# EasyEDA Pro project 电脑鼠SYR.eprj, board PCB1
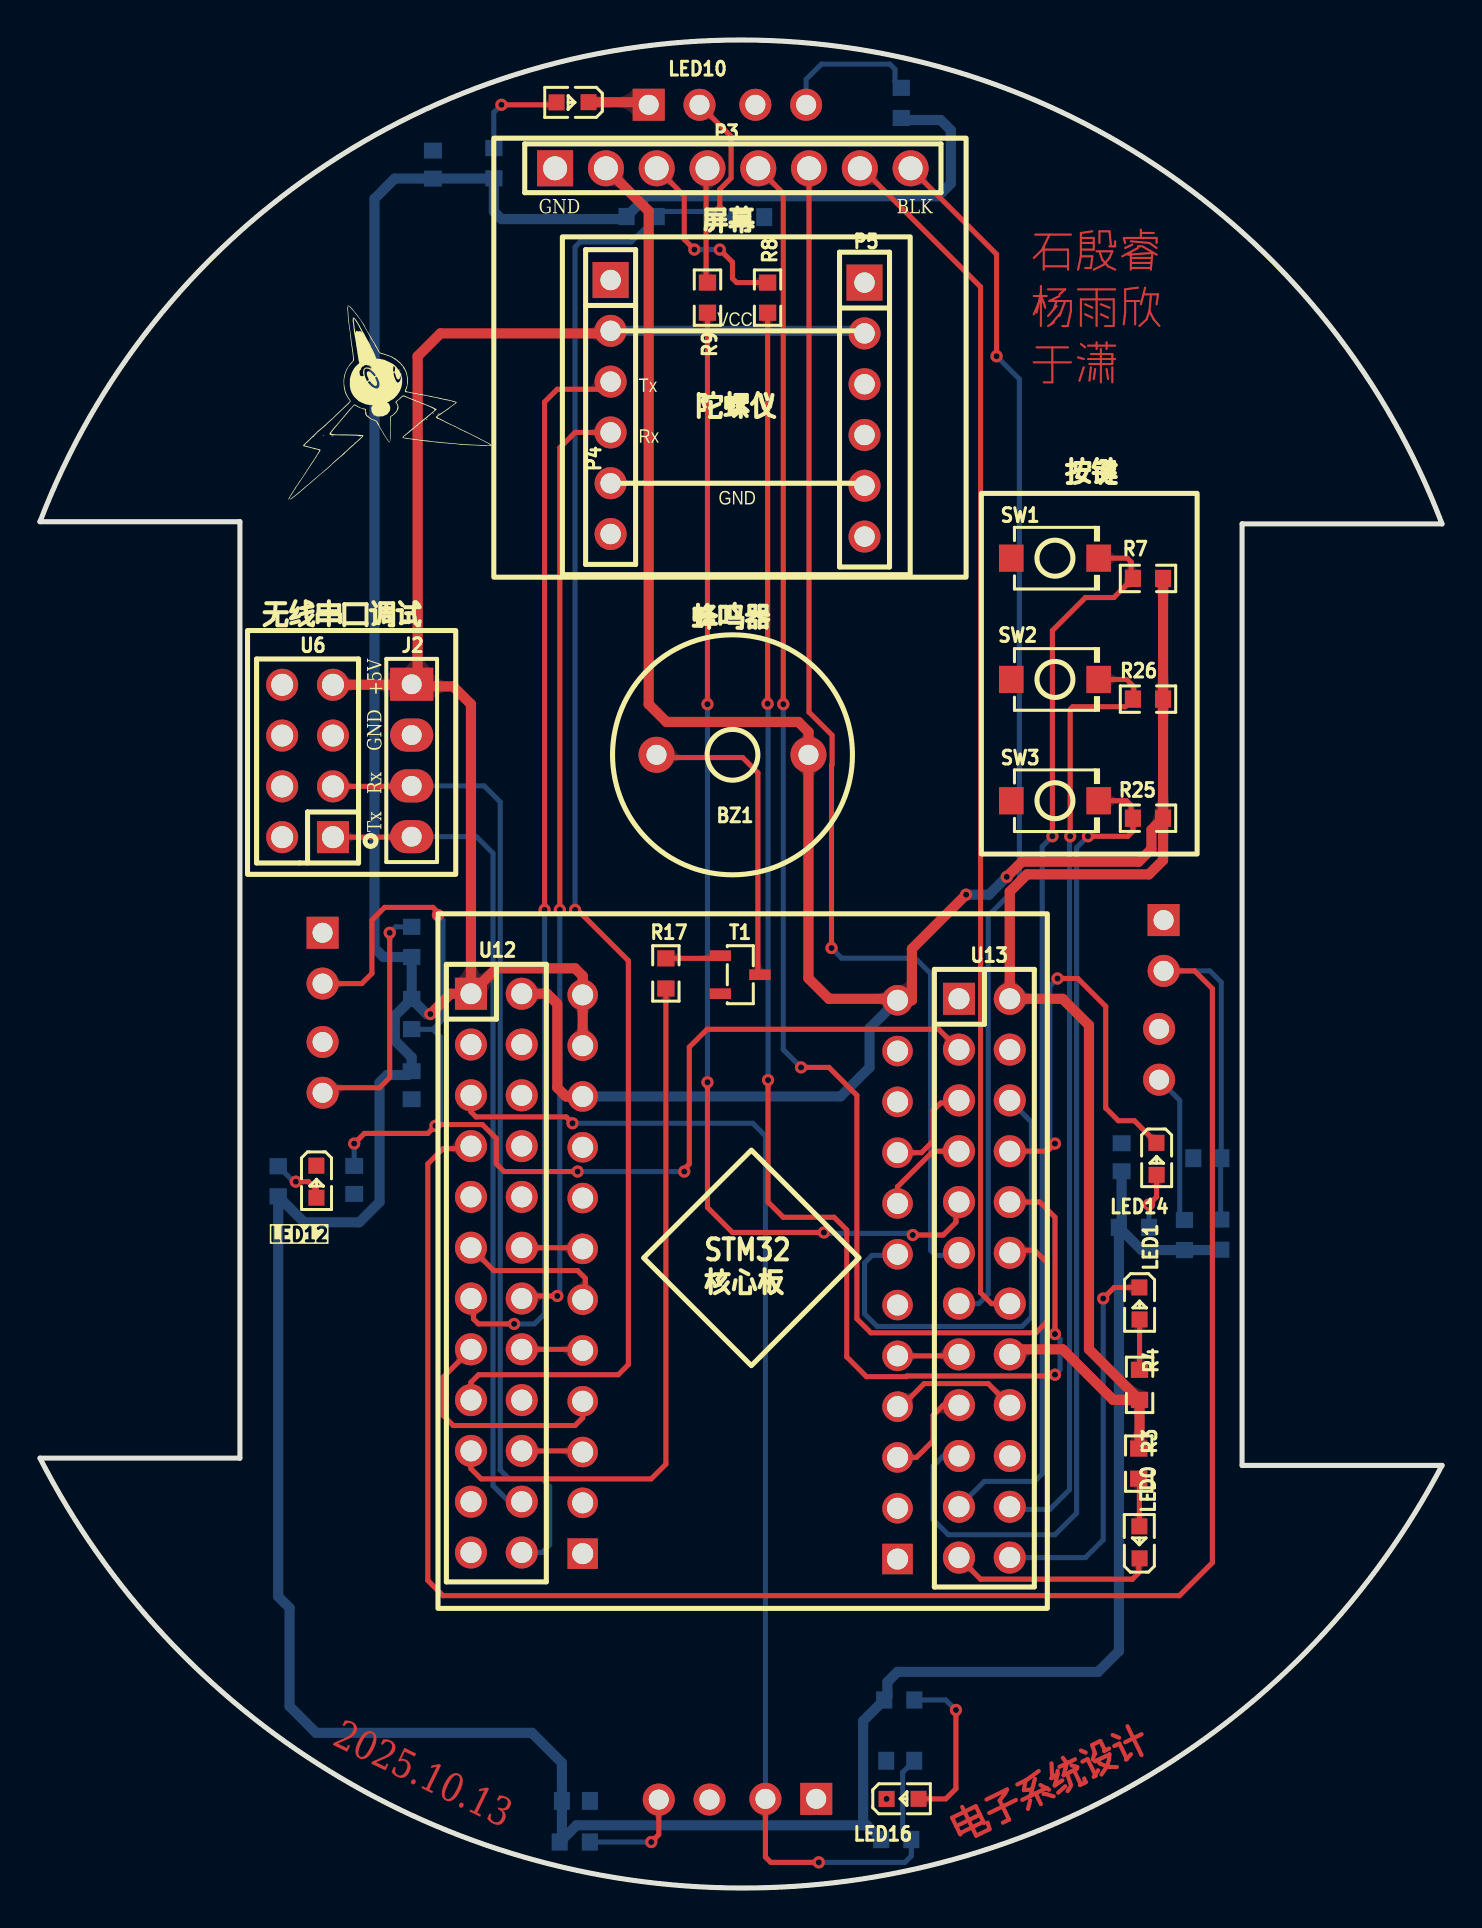
[diagram p2: board, top side]
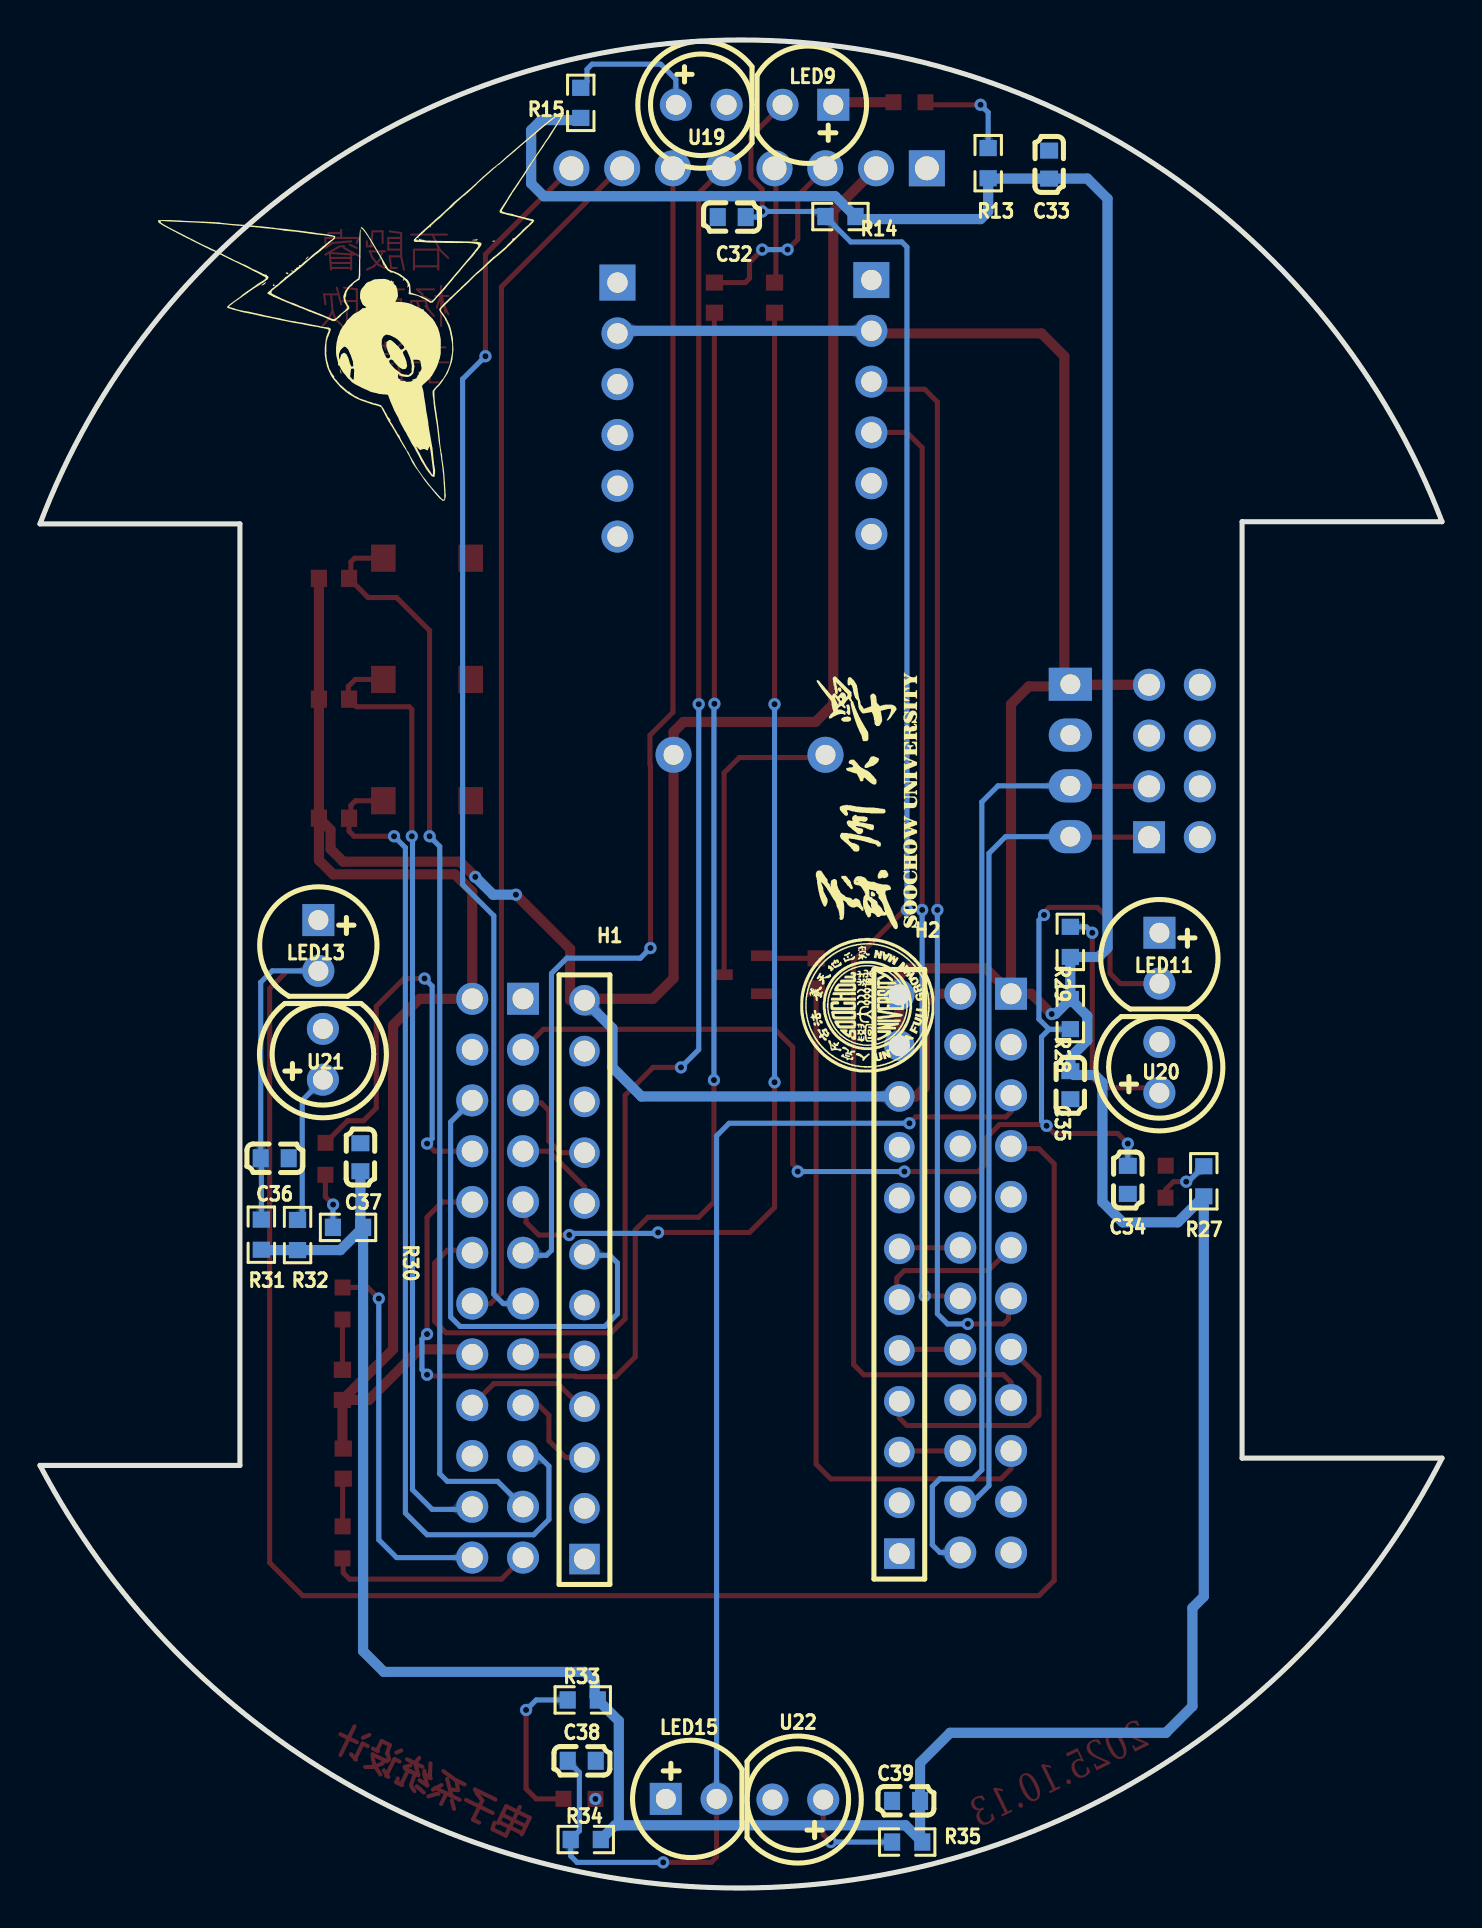
[diagram p3: board, bottom side, seen from below]

Outline 70.13 x 92.41 mm; copper layers: Top Layer, Bottom Layer. Coordinates in mm from the lower left corner of the outline.
Outline path: 0,68.32 arc(35.1,92.41) 70.13,68.21 60.13,68.21 60.13,21.13 70.13,21.13 arc(34.95,0) 0,21.49 10,21.49 10,68.32 0,68.32
Stack: Top Layer 0.035mm / Dielectric1 1.51mm FR4 er 4.5 / Bottom Layer 0.035mm

## Design rules (mm)
template: 自定义配置
spacing copperThickness1oz (default): track to track 0.102, other pairs 0.152 to 0.3
spacing copperThickness2oz: track to track 0.203, other pairs 0.152 to 0.3
track width copperThickness1oz (default): min 0.127, default 0.254, max 2.54
track width copperThickness2oz: min 0.381, default 0.381, max 2.54
differential pair differentialPair (default): width min 0.127, default 0.254, max 2.54; gap min 0.152, default 0.152
via viaSize (default): diameter min 0.5, default 0.61, max 10; hole min 0.3, default 0.305, max 6.299
net +5V uses copperThickness2oz
net 3V3 uses copperThickness2oz

## Placement (name value [footprint] x y rotation side)
BZ1  2.7kHz  [BUZ-TH_BD12.0-P7.60-D0.6-FD]  34.64 56.66 180 top
C32  104  [C0603]  35.53 83.55 180 bottom
C33  104  [C0603]  19.65 86.18 270 bottom
C34  104  [C0603]  15.72 35.41 90 bottom
C35  104  [C0603]  18.59 40.14 90 bottom
C36  104  [C0603]  58.39 36.49 0 bottom
C37  104  [C0603]  54.1 36.54 270 bottom
C38  104  [C0603]  43.03 6.36 0 bottom
C39  104  [C0603]  26.81 4.36 180 bottom
H1  -  [HDR-TH_12P-P2.54-V-M]  42.89 30.42 90 bottom
H2  -  [HDR-TH_12P-P2.54-V-M]  27.14 30.69 90 bottom
J2  null  [HEADER1X4]  18.72 56.38 270 top
LED0  XL-1608SURC-06  [LED0603-RD_RED]  54.99 17.28 90 top
LED1  XL-1608SURC-06  [LED0603-RD_RED]  54.99 29.23 270 top
LED9  MHL524PT03BRT  [LED-TH_BD5.8-P2.54-RD]  31.72 89.17 0 bottom
LED10  XL-1608SURC-06  [LED0603-RD_RED]  26.64 89.29 180 top
LED11  MHL524PT03BRT  [LED-TH_BD5.8-P2.54-RD]  14.13 46.49 270 bottom
LED12  XL-1608SURC-06  [LED0603-RD_RED]  13.83 35.32 270 top
LED13  MHL524PT03BRT  [LED-TH_BD5.8-P2.54-RD]  56.2 47.13 270 bottom
LED14  XL-1608SURC-06  [LED0603-RD_RED]  55.85 36.46 270 top
LED15  MHL524PT03BRT  [LED-TH_BD5.8-P2.54-RD]  37.55 4.46 180 bottom
LED16  XL-1608SURC-06  [LED0603-RD_RED]  43.14 4.46 0 top
P3  null  [HDR-TH_8P-P2.54-V-F-1]  34.66 85.99 0 top
P4  2.54-1*6P母  [HDR-TH_6P-P2.54-V-F]  28.54 74.05 270 top
P5  2.54-1*6P母  [HDR-TH_6P-P2.54-V-F]  41.24 73.93 270 top
R3  4.7kΩ  [R0603]  54.96 21.22 270 top
R4  4.7kΩ  [R0603]  55 25.16 90 top
R7  4.7kΩ  [R0603]  55.42 65.48 0 top
R8  100Ω  [R0603]  36.39 79.52 270 top
R9  100Ω  [R0603]  33.39 79.52 270 top
R13  1K  [R0603]  22.7 86.25 270 bottom
R14  10K  [R0603]  30.09 83.58 180 bottom
R15  100  [R0603]  43.08 89.26 270 bottom
R17  100Ω  [R0603]  31.31 45.73 90 top
R25  4.7kΩ  [R0603]  55.42 53.49 0 top
R26  4.7kΩ  [R0603]  55.42 59.45 0 top
R27  1K  [R0603]  11.92 35.34 270 bottom
R28  10K  [R0603]  18.59 43.7 90 bottom
R29  100  [R0603]  18.59 47.31 270 bottom
R30  1K  [R0603]  54.72 33.03 180 bottom
R31  10K  [R0603]  59.05 32.67 270 bottom
R32  100  [R0603]  57.24 32.65 270 bottom
R33  1K  [R0603]  42.98 9.4 180 bottom
R34  10K  [R0603]  42.83 2.42 180 bottom
R35  100  [R0603]  26.75 2.3 180 bottom
SW1  TS-1088-AR02016  [SW-SMD_L3.9-W3.0-P4.45]  50.77 66.49 0 top
SW2  TS-1088-AR02016  [SW-SMD_L3.9-W3.0-P4.45]  50.77 60.43 0 top
SW3  TS-1088-AR02016  [SW-SMD_L3.9-W3.0-P4.45]  50.77 54.37 0 top
T1  S8050  [SOT-23-3_L2.9-W1.3-P1.90-LS2.3-BR]  35.02 45.67 180 top
U6  null  [HDR-TH_8P-P2.54-V-F-R2-C4-S2.54-1]  13.38 56.35 90 top
U12  null  [HDR-TH_24P-P2.54-V-F-R2-C12-S2.54-2]  22.83 30.75 270 top
U13  null  [HDR-TH_24P-P2.54-V-F-R2-C12-S2.54-2]  47.24 30.49 270 top
U19  IR333C-A(BY)(Q)  [LED-TH_BD5.0-P2.54-FD]  37.05 89.17 180 bottom
U20  IR333C-A(BY)(Q)  [LED-TH_BD5.0-P2.54-FD]  14.14 41.03 90 bottom
U21  IR333C-A(BY)(Q)  [LED-TH_BD5.0-P2.54-FD]  55.98 41.69 90 bottom
U22  IR333C-A(BY)(Q)  [LED-TH_BD5.0-P2.54-FD]  32.22 4.42 0 bottom

## Footprints (pads in the part's own frame, mm; a bottom-side part is the same pattern mirrored in y, then rotated)
BUZ-TH_BD12.0-P7.60-D0.6-FD
  round 1.8 hole 1: 1(-3.8,0) 2(3.8,0)
C0603
  rect 0.8x0.9 smd: 1(-0.7,0) 2(0.7,0)
HDR-TH_6P-P2.54-V-F
  rect 1.8x1.8 hole 1.02: 1(-6.35,0)
  round 1.6 hole 1.02: 2(-3.81,0) 3(-1.27,0) 4(1.27,0) 5(3.81,0) 6(6.35,0)
HDR-TH_8P-P2.54-V-F-1
  rect 1.8x1.8 hole 1.2: 1(-8.89,0)
  round 1.8 hole 1.2: 2(-6.35,0) 3(-3.81,0) 4(-1.27,0) 5(1.27,0) 6(3.81,0) 7(6.35,0) 8(8.89,0)
HDR-TH_8P-P2.54-V-F-R2-C4-S2.54-1
  rect 1.6x1.6 hole 1.1: 1(-3.81,-1.27)
  round 1.6 hole 1.1: 2(-3.81,1.27) 3(-1.27,-1.27) 4(-1.27,1.27) 5(1.27,-1.27) 6(1.27,1.27) 7(3.81,-1.27) 8(3.81,1.27)
HDR-TH_12P-P2.54-V-M
  rect 1.524x1.524 hole 1.05: 1(-13.97,0)
  round 1.524 hole 1.05: 2(-11.43,0) 3(-8.89,0) 4(-6.35,0) 5(-3.81,0) 6(-1.27,0) 7(1.27,0) 8(3.81,0) 9(6.35,0) 10(8.89,0) 11(11.43,0) 12(13.97,0)
HDR-TH_24P-P2.54-V-F-R2-C12-S2.54-2
  rect 1.6x1.6 hole 1.05: 1(-13.97,-1.27)
  round 1.6 hole 1.05: 2(-13.97,1.27) 3(-11.43,-1.27) 4(-11.43,1.27) 5(-8.89,-1.27) 6(-8.89,1.27) 7(-6.35,-1.27) 8(-6.35,1.27) 9(-3.81,-1.27) 10(-3.81,1.27) 11(-1.27,-1.27) 12(-1.27,1.27) 13(1.27,-1.27) 14(1.27,1.27) 15(3.81,-1.27) 16(3.81,1.27) 17(6.35,-1.27) 18(6.35,1.27) 19(8.89,-1.27) 20(8.89,1.27) 21(11.43,-1.27) 22(11.43,1.27) 23(13.97,-1.27) 24(13.97,1.27)
HEADER1X4
  rect 1.651x2.159 hole 0.991x0.996: 1(-3.81,-0.127)
  oval 1.651x2.159 hole 0.991x0.996: 2(-1.27,-0.127) 3(1.27,-0.127) 4(3.81,-0.127)
LED0603-RD_RED
  rect 0.8x0.8 smd: 1(-0.799,-0.004) 2(0.799,0.004)
LED-TH_BD5.0-P2.54-FD
  round 1.6 hole 1: 1(-1.27,0) 2(1.27,0)
LED-TH_BD5.8-P2.54-RD
  round 1.6 hole 1: 1(1.27,0)
  rect 1.6x1.6 hole 1: 2(-1.27,0)
R0603
  rect 0.806x0.864 smd: 1(-0.753,0) 2(0.753,0)
SOT-23-3_L2.9-W1.3-P1.90-LS2.3-BR
  rect 1.07x0.532 smd: 1(0.99,-0.95) 2(0.99,0.95) 3(-0.99,0)
SW-SMD_L3.9-W3.0-P4.45
  rect 1.23x1.36 smd: 1(-2.185,0) 2(2.185,0)

## Nets
As in the schematic.

Pads without a net: P4 1 6; P5 1 3 4 6; U6 2 4 8

## Via types
v1: diameter 0.61, hole 0.305, Top Layer to Bottom Layer, 43 vias

## Routing (per net, layer and track width the routed paths; a pad name or vN(x,y) marks a point on that pad's centre or on a via; arc(x,y) is an arc through that point)
3V3: length 161.3
  Top Layer w0.508: R25.2 55.59,52.91 55.59,51.95 54.96,51.32 49.12,51.32 v1(48.35,50.56) ; R25.2 R26.2 R7.2 ; R25.2 56.17,51.39 55.47,50.68 49.37,50.68 48.51,49.82 U13.2 51.15,44.46 52.47,43.14 52.47,26.93 R4.1 ; R3.1 55,22.01 R4.1 ; U12.2 25.37,44.72 25.88,44.21 25.88,40.02 26.31,39.58 H2.10 ; v1(46.32,49.67) 43.61,46.96 43.61,44.39 H1.12 42.82,44.46 39.46,44.46 38.44,45.49 BZ1.1 38.44,57.81 37.94,58.3 31.34,58.3 30.45,59.19 30.45,83.85 P3.2 ; R4.1 53.68,24.4 51.15,26.94 48.76,26.94 U13.16
  Bottom Layer w0.508: v1(46.32,49.67) 47.47,49.67 v1(48.35,50.56) ; H1.12 41.5,42.99 41.5,41.03 40.04,39.58 H2.10
+5V: length 282.3
  Top Layer w0.508: P4.2 28.42,77.74 20.03,77.74 18.89,76.59 18.89,60.49 J2.1 ; U12.1 20.54,44.72 v1(19.53,43.7) ; U12.1 22.83,45.99 26.76,45.99 27.14,45.6 H2.12 H2.11 ; U12.1 21.56,59.19 20.67,60.08 18.7,60.08 J2.1 ; J2.1 18.57,60.16 14.65,60.16
  Bottom Layer w0.508: R30.2 55.1,31.9 R32.2 59.04,31.9 R31.2 ; R30.2 54.1,33.17 C37.2 ; R30.2 53.97,11.85 52.93,10.81 42.89,10.81 42.39,10.3 42.39,9.56 R33.2 41.17,8.35 41.17,3.14 ; P5.2 41.11,77.86 P4.2 ; 26.11,2.41 26,2.3 ; 26.11,2.41 26.84,3.14 41.17,3.14 ; 26.11,2.41 C39.2 26.11,6.26 24.61,7.76 13.81,7.76 12.48,9.08 12.48,14 11.92,14.57 R27.2 13.21,33.29 15.97,33.29 16.98,34.3 16.98,40.27 17.37,40.65 18.4,40.65 C35.2 18.59,41.54 17.75,42.38 17.75,43.61 R28.2 ; R28.2 19.34,43.7 v1(19.53,43.7) ; R28.2 R29.2 17.18,46.55 16.73,47 16.73,84.47 17.74,85.48 C33.2 22.68,85.48 R13.2 22.7,83.83 23.08,83.45 29.21,83.45 R14.2 30.35,84.59 44.92,84.59 45.56,85.23 45.56,87.9 45.05,88.4 43.18,88.4 R15.2 ; 41.17,3.14 41.36,3.14 R34.2
GND: length 25.3
  Top Layer w0.254: LED14.1 54.74,38.37 53.94,38.37 53.31,39 53.31,44.08 51.91,45.48 v1(50.89,45.48) ; U13.8 50.39,36.84 v1(50.77,37.22)
  Top Layer w0.508: LED10.1 30.32,89.3 LED9.2
  Bottom Layer w0.254: v1(50.77,37.22) 50.51,37.48 50.51,45.1 v1(50.89,45.48)
  vias: v1(42.34,4.45)
BAT_ADC: length 3.1
  Top Layer w0.254: H2.3 27.09,21.86 U12.20
BEEP: length 34.9
  Top Layer w0.254: R17.1 31.31,21.19 30.57,20.46 22.07,20.46 21.56,20.97 U12.19
DETECT0: length 81.3
  Top Layer w0.254: U12.17 21.56,25.28 21.94,25.67 28.92,25.67 29.43,26.17 29.43,46.37 26.89,48.91 v1(26.76,48.91) ; LED9.1 34.57,87.59 34.57,85.5 34,84.94 v1(34,83.83)
  Bottom Layer w0.254: C32.2 34.28,83.55 v1(34,83.83) 31.1,83.83 R14.1 29.57,82.31 27.02,82.31 26.76,82.05 v1(26.76,48.91)
DETECT1: length 61.7
  Top Layer w0.254: v1(19.91,48.65) 19.91,48.78 19.65,49.03 17.24,49.03 16.6,48.4 16.6,45.73 16.1,45.22 LED11.1 ; v1(26.89,35.83) 23.21,35.83 22.83,36.21 22.83,37.48 22.13,38.18 19.84,38.18 v1(19.78,38.11) 19.4,37.73 16.22,37.73 v1(15.72,37.22) ; v1(32.23,35.83) 32.23,35.95 32.48,36.21 32.48,42.05 33.37,42.94 44.95,42.94 45.97,41.92
  Bottom Layer w0.254: v1(19.91,48.65) 20.16,48.4 20.16,43.45 19.65,42.94 ; 19.65,42.94 20.03,42.56 20.03,38.37 v1(19.78,38.11) ; 19.65,42.94 18.6,42.94 R28.1 ; v1(32.23,35.83) v1(26.89,35.83) ; v1(15.72,37.22) C34.2
DETECT2: length 110.1
  Top Layer w0.254: LED13.1 57.75,45.86 58.64,44.97 58.64,16.27 56.99,14.62 20.16,14.62 19.4,15.38 19.4,36.21 20.16,36.97 21.43,36.97 21.56,37.1
  Bottom Layer w0.254: LED13.1 58.51,45.86 59.09,45.29 C36.2 59.05,36.46 R31.1
DETECT3: length 64.8
  Top Layer w0.254: v1(26.64,38.24) 26.32,38.56 21.81,38.56 21.56,38.81 U12.5 ; LED15.1 36.29,1.55 36.55,1.28 v1(38.96,1.28)
  Bottom Layer w0.254: C38.2 43.15,5.78 43.15,2.86 R34.1 43.58,1.6 43.26,1.28 v1(38.96,1.28) ; v1(26.64,38.24) 35.65,38.24 36.29,37.61 LED15.1
DIR_L1: length 3.1
  Top Layer w0.254: H1.5 45.89,26.61 U13.15
DIR_L2: length 6.5
  Top Layer w0.254: H1.4 43.07,24.07 44.23,25.22 47.43,25.22 48.51,24.14
DIR_R1: length 24.5
  Bottom Layer w0.254: H1.7 42.84,31.63 41.62,31.63 41.24,31.25 41.24,28.71 41.88,28.08 49.12,28.08 49.59,28.55 49.59,38.3 U13.6
DIR_R2: length 4.6
  Top Layer w0.254: U13.7 44.67,36.84 42.89,35.06 H1.8
ENC_LA: length 3.1
  Top Layer w0.254: U12.16 27.09,26.94 H2.5
ENC_LB: length 12.1
  Top Layer w0.254: H2.4 27.14,23.51 26.76,23.13 20.67,23.13 20.16,23.63 20.16,25.54 U12.15
ENC_RA: length 3.1
  Top Layer w0.254: H2.7 27.09,32.02 24.1,32.02
ENC_RB: length 7.5
  Top Layer w0.254: 21.56,32.02 22.7,30.87 26.89,30.87 27.27,30.49 27.27,29.55 H2.6
IMU_RX1: length 47.2
  Top Layer w0.254: P4.4 26.76,72.78 26,72.02 v1(26,48.91) ; U12.14 24.22,29.6 v1(25.88,29.6)
  Bottom Layer w0.254: v1(25.88,29.6) 26,29.73 v1(26,48.91)
IMU_TX1: length 54.3
  Top Layer w0.254: v1(25.24,48.91) 25.24,74.31 25.88,74.94 28.16,74.94 P4.3 ; U12.13 21.68,29.35 21.68,28.45 21.93,28.21 v1(23.72,28.21)
  Bottom Layer w0.254: v1(25.24,48.91) 25.24,28.71 24.73,28.21 v1(23.72,28.21)
KEY0: length 54.9
  Top Layer w0.254: v1(50.64,52.59) 50.64,62.88 52.29,64.53 53.71,64.53 R7.1 54.58,65.57 54.58,66.31 54.39,66.49 SW1.2
  Bottom Layer w0.254: v1(50.64,52.59) 50.13,52.08 50.13,20.71 49.75,20.33 47.24,20.33 U13.21
KEY1: length 48.4
  Top Layer w0.254: v1(51.53,52.59) 51.53,58.94 51.66,59.07 54.29,59.07 R26.1 54.7,59.48 54.7,60.08 54.36,60.43 SW2.2
  Bottom Layer w0.254: v1(51.53,52.59) 51.49,52.56 51.49,19.92 50.51,18.93 48.63,18.93 U13.22
KEY2: length 51.6
  Top Layer w0.254: SW3.2 54.34,54.37 54.58,54.13 54.58,53.58 R25.1 54.67,52.84 54.41,52.59 v1(52.42,52.59)
  Bottom Layer w0.254: U13.19 45.18,21.6 44.67,21.09 44.67,18.43 45.43,17.66 50.77,17.66 51.85,18.75 51.85,52.02 v1(52.42,52.59)
LED0: length 10.3
  Top Layer w0.254: LED0.1 54.96,16.45 54.96,15.76 54.64,15.44 47.05,15.44 U13.23
LED1: length 19.1
  Top Layer w0.254: 54.99,30.03 53.73,30.03 v1(53.18,29.48)
  Bottom Layer w0.254: v1(53.18,29.48) 53.18,17.41 52.29,16.52 U13.24
OLED_BLK: length 60.9
  Top Layer w0.254: v1(47.85,76.59) 47.85,81.69 P3.8
  Bottom Layer w0.254: v1(47.85,76.59) 48.99,75.45 48.99,50.18 47.43,48.61 47.43,29.69 46.96,29.22 45.97,29.22
OLED_CS: length 60.5
  Top Layer w0.254: P3.7 41.11,85.99 47.05,80.06 47.05,29.77 47.59,29.22 48.51,29.22
OLED_DC: length 60.4
  Top Layer w0.254: P3.6 38.47,58.79 39.62,57.64 39.62,56.17 39.59,56.15 v1(39.59,47)
  Bottom Layer w0.254: v1(39.59,47) 40.1,46.49 43.78,46.49 44.54,45.73 44.54,31.89 44.8,31.63 45.84,31.63 U13.11
OLED_RST: length 75.6
  Top Layer w0.254: v1(38.07,41.03) 39.46,41.03 40.86,39.64 40.86,28.46 41.56,27.76 49.81,27.76 50.39,28.33 50.39,31.25 49.75,31.89 48.63,31.89 U13.12 ; P3.5 37.18,84.74 v1(37.18,59.19)
  Bottom Layer w0.254: v1(37.18,59.19) 37.18,41.92 v1(38.07,41.03)
OLED_SCL: length 76.9
  Top Layer w0.254: v1(36.42,40.4) 36.42,34.3 37.18,33.54 39.72,33.54 40.35,32.9 40.35,26.55 41.34,25.57 43.32,25.57 43.36,25.6 50.7,25.6 v1(50.77,25.67) ; v1(50.77,27.7) 50.77,33.54 50.01,34.3 U13.10 ; R8.2 v1(36.39,59.22) 36.42,59.19
  Bottom Layer w0.254: v1(50.77,25.67) 51.02,25.92 51.02,27.44 v1(50.77,27.7) ; v1(36.39,59.22) 36.42,59.19 v1(36.42,40.4)
OLED_SDA: length 59.1
  Top Layer w0.254: v1(43.66,32.65) 45.18,32.65 45.81,33.29 45.81,34.15 U13.9 ; v1(39.21,32.78) 34.64,32.78 33.39,34.03 v1(33.39,40.29) ; R9.2 v1(33.39,59.19)
  Bottom Layer w0.254: v1(39.21,32.78) 39.26,32.73 43.58,32.73 v1(43.66,32.65) ; v1(33.39,59.19) v1(33.39,40.29) 33.37,40.27
PWM_L: length 4.9
  Top Layer w0.254: H1.3 43.84,21.53 44.67,22.36 44.67,23.63 45.18,24.14 45.97,24.14
PWM_R: length 5
  Top Layer w0.254: U13.5 45.84,39.25 45.05,39.25 44.67,38.87 44.67,37.35 44.09,36.77 H1.9
RX: length 49.4
  Top Layer w0.254: J2.3 18.57,55.08 14.65,55.08
  Bottom Layer w0.254: U12.24 25.11,16.78 25.49,17.16 25.49,20.08 25.11,20.46 23.46,20.46 23.02,20.9 23.02,54.3 22.21,55.11 J2.3
TX: length 41.8
  Top Layer w0.254: J2.4 18.57,52.54 14.65,52.54
  Bottom Layer w0.254: J2.4 21.83,52.57 22.66,51.74 22.66,20.12 23.3,19.48 23.93,19.48 24.1,19.32
$1N2633: length 2.8
  Top Layer w0.254: R17.2 33.9,46.49 T1.1
$1N2636: length 15.6
  Top Layer w0.254: BZ1.2 30.97,56.53 35.15,56.53 35.91,55.76 35.91,45.77 T1.3
$1N2649: length 9.7
  Top Layer w0.254: v1(34,81.93) 34.64,81.29 34.64,80.48 34.85,80.28 R8.1 ; P3.3 32.23,84.61 32.23,82.43 v1(32.73,81.93)
  Bottom Layer w0.254: v1(34,81.93) v1(32.73,81.93)
$1N2650: length 5.8
  Top Layer w0.254: R9.1 33.32,80.35 33.32,85.92 P3.4
$1N2827: length 2.4
  Top Layer w0.254: R3.2 54.99,20.44 LED0.2
$1N2828: length 2.5
  Top Layer w0.254: LED1.2 55,28.43 R4.2
$1N15701: length 5.1
  Top Layer w0.254: LED10.2 25.71,89.17 v1(23.08,89.17)
  Bottom Layer w0.254: v1(23.08,89.17) 22.7,88.78 R13.1
$1N15702: length 7.2
  Bottom Layer w0.254: R15.1 42.77,90.33 42.77,90.94 42.51,91.2 39.08,91.2 38.32,90.44 U19.1
$1N16012: length 2.8
  Top Layer w0.254: LED12.2 13.81,34.54 13.81,34.94 13.43,35.32 v1(12.79,35.32)
  Bottom Layer w0.254: R27.1 12.69,35.32 v1(12.79,35.32)
$1N16013: length 12.1
  Top Layer w0.254: v1(17.49,47.76) 17.49,40.52 16.98,40.02 14.39,40.02 U20.1
  Bottom Layer w0.254: v1(17.49,47.76) 17.79,48.06 R29.1
$1N16276: length 2.8
  Top Layer w0.254: LED14.2 55.85,34.56 v1(55.47,34.17)
  Bottom Layer w0.254: R30.1 55.47,34.17 v1(55.47,34.17)
$1N16277: length 7.5
  Bottom Layer w0.254: R32.1 57.01,33.64 57.01,39.39 U21.1
$1N16540: length 8.3
  Top Layer w0.254: v1(45.81,8.9) 45.81,4.96 45.31,4.46 43.95,4.46 LED16.2
  Bottom Layer w0.254: R33.1 45.31,9.4 45.81,8.9 v1(45.81,8.9)
$1N16541: length 5.3
  Top Layer w0.254: U22.1 30.95,2.67 v1(30.57,2.3)
  Bottom Layer w0.254: v1(30.57,2.3) R35.1

## Copper pours and planes (outline as drawn; the poured copper is in the pictures)
GND on Top Layer: -14.89,98.94 94.2,98.94 94.2,-11.55 -14.89,-11.55
GND on Bottom Layer: -21.11,96.79 86.2,96.79 86.2,-13.32 -21.11,-13.32

Small or netless copper shapes (teardrops, artwork), in the pictures only: 151 on Top Layer, 75 on Bottom Layer

## Text on the board
Top Layer: 2025.10.13 | 电子系统设计 | 石殷睿 / 杨雨欣 / 于潇
Top Solder Mask Layer: 2025.10.13 | 电子系统设计 | 石殷睿 / 杨雨欣 / 于潇
Top Silkscreen Layer: Tx | Rx | VCC | GND | +5V | BLK | 无线串口调试 | 蜂鸣器 | 陀螺仪 | 屏幕 | STM32 / 核心板 | 按键
